# EasyEDA Pro project MSDRV3.eprj, schematic BBC_reuse
Create Date: 2024-11-12; Page Name: P1; Project Name: MSDRV3; Schematic Name: BBC_reuse; Update Date: 2024-11-22; Company: EasyEDA.com; Drawn: EasyEDA; Page Size: A4; Part Number: JLCPCB-002; Reviewed: EasyEDA; Version: V0.1
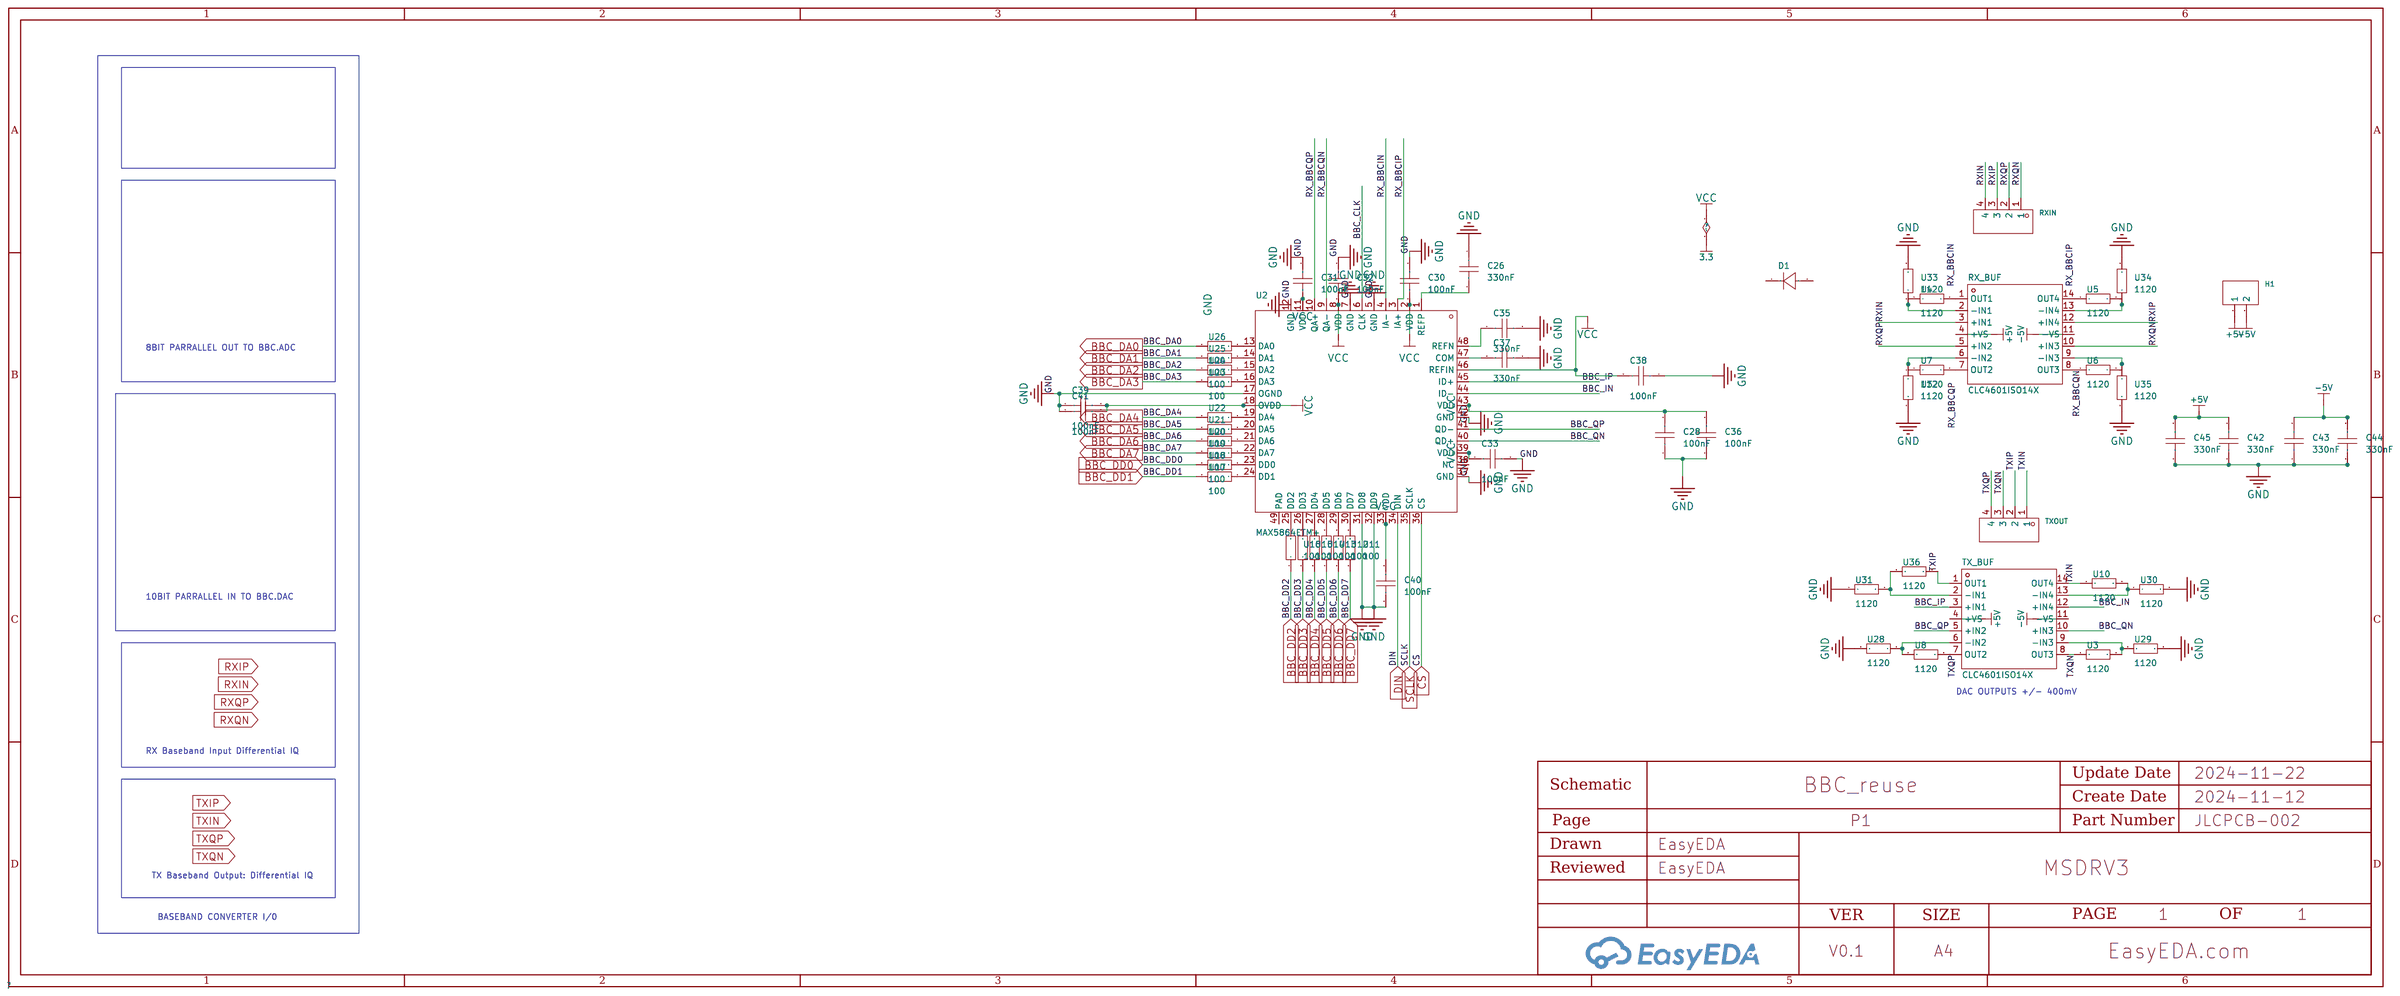
[diagram p2: schematic sheet]

## Parts
C26  330nF  [C0805]
C28  100nF  [C0805]
C30  100nF  [C0805]
C31  100nF  [C0805]
C32  100nF  [C0805]
C33  100nF  [C0805]
C35  330nF  [C0805]
C36  100nF  [C0805]
C37  330nF  [C0805]
C38  100nF  [C0805]
C39  100nF  [C0805]
C40  100nF  [C0805]
C41  100nF  [C0805]
C42  330nF  [C0805]
C43  330nF  [C0805]
C44  330nF  [C0805]
C45  330nF  [C0805]
D1  -  [SMA_L4.4-W2.8-LS5.4-RD]
H1  -  [HDR-TH_2P-P2.54-V-F]
RX_BUF  CLC4601ISO14X  [SOIC-14_L8.7-W3.9-P1.27-LS6.0-BL]
RXIN  -  [HDR-TH_4P-P2.54-V-F]
TX_BUF  CLC4601ISO14X  [SOIC-14_L8.7-W3.9-P1.27-LS6.0-BL]
TXOUT  -  [HDR-TH_4P-P2.54-V-F]
U2  MAX5864ETM+  [QFN-48_L7.0-W7.0-P0.50-BL-EP5.1]
U3  1120  [R0805]
U4  1120  [R0805]
U5  1120  [R0805]
U6  1120  [R0805]
U7  1120  [R0805]
U8  1120  [R0805]
U10  1120  [R0805]
U11  100  [R0805]
U12  100  [R0805]
U13  100  [R0805]
U14  100  [R0805]
U15  100  [R0805]
U16  100  [R0805]
U17  100  [R0805]
U18  100  [R0805]
U19  100  [R0805]
U20  100  [R0805]
U21  100  [R0805]
U22  100  [R0805]
U23  100  [R0805]
U24  100  [R0805]
U25  100  [R0805]
U26  100  [R0805]
U28  1120  [R0805]
U29  1120  [R0805]
U30  1120  [R0805]
U31  1120  [R0805]
U32  1120  [R0805]
U33  1120  [R0805]
U34  1120  [R0805]
U35  1120  [R0805]
U36  1120  [R0805]

## Library data of the parts
C26 C28 C30-C33 C35-C45 = CAP_0805: Supplier Footprint: 0805
D1 = 1N4007: Supplier Footprint: SMA(DO-214AC); Supplier Part: C727081
H1 = HDR-F_2.54_1x2P: Supplier Footprint: Through
RX_BUF TX_BUF = CLC4601ISO14X: Number of Circuits:; Supplier Part: C49944; Supplier Footprint: SOIC-14; JLCPCB Part Class: Extended Part; Supplier: LCSC
RXIN TXOUT = HDR-F_2.54_1x4P: Supplier Footprint: Through
U2 = MAX5864ETM+: Supply Voltage:2.7V~3.3V Supply Voltage:2.7V~3.3V; LCSC Part Name: MAX5864ETM; Supplier Part: C143525; Manufacturer: ADI(亚德诺)/MAXIM(美信); Supplier Footprint: QFN-48-EP(7x7); JLCPCB Part Class: Extended Part; Datasheet: https://atta.szlcsc.com/upload/public/pdf/source/20171204/C143525_15123772477351162683.pdf; Supplier: LCSC; Supply Voltage: 2.7V~3.3V
U3-U8 U10-U26 U28-U36 = 3R00: Supplier Part: C9900008006; JLCPCB Part Class: Extended Part; Supplier: LCSC

## Nets
+5V: C42.2 C45.2 H1.1 RX_BUF.4(+VS) TX_BUF.4(+VS)
-5V: C43.2 C44.2 H1.2 RX_BUF.11(-VS) TX_BUF.11(-VS)
GND: C26.1 C28.1 C30.2 C31.1 C32.1 C33.2 C35.2 C36.1 C37.1 C38.1 C39.1 C40.1 C41.1 C42.1 C43.1 C44.1 C45.1 U2.5(GND) U2.7(GND) U2.12(GND) U2.17(OGND) U2.31(DD8) U2.32(DD9) U2.37(GND) U2.42(GND) U28.2 U29.2 U30.2 U31.1 U32.2 U33.2 U34.2 U35.2
3.3: C28.2 C30.1 C31.2 C32.2 C33.1 C36.2 C38.2 C39.2 C40.2 C41.2 U2.2(VDD) U2.8(VDD) U2.11(VDD) U2.18(OVDD) U2.33(VDD) U2.39(VDD) U2.43(VDD) U2.46(REFIN)
BBC_CLK: U2.6(CLK)
BBC_DA0: U26.2
BBC_DA1: U25.2
BBC_DA2: U24.2
BBC_DA3: U23.2
BBC_DA4: U22.2
BBC_DA5: U21.2
BBC_DA6: U20.2
BBC_DA7: U19.2
BBC_DD0: U18.2
BBC_DD1: U17.2
BBC_DD2: U16.1
BBC_DD3: U15.1
BBC_DD4: U14.1
BBC_DD5: U13.1
BBC_DD6: U12.1
BBC_DD7: U11.1
BBC_IN: TX_BUF.12(+IN4) U2.44(ID-)
BBC_IP: TX_BUF.3(+IN1) U2.45(ID+)
BBC_QN: TX_BUF.10(+IN3) U2.40(QD+)
BBC_QP: TX_BUF.5(+IN2) U2.41(QD-)
CS: U2.36(CS)
DIN: U2.34(DIN)
RX_BBCIN: RX_BUF.1(OUT1) U2.4(IA-) U4.2
RX_BBCIP: RX_BUF.14(OUT4) U2.3(IA+) U5.1
RX_BBCQN: RX_BUF.8(OUT3) U2.9(QA-) U6.1
RX_BBCQP: RX_BUF.7(OUT2) U2.10(QA+) U7.2
RXIN: RX_BUF.3(+IN1) RXIN.4
RXIP: RX_BUF.12(+IN4) RXIN.3
RXQN: RX_BUF.10(+IN3) RXIN.1
RXQP: RX_BUF.5(+IN2) RXIN.2
SCLK: U2.35(SCLK)
TXIN: TX_BUF.14(OUT4) TXOUT.1 U10.1
TXIP: TX_BUF.1(OUT1) TXOUT.2 U36.2
TXQN: TX_BUF.8(OUT3) TXOUT.3 U3.1
TXQP: TX_BUF.7(OUT2) TXOUT.4 U8.2
$1N3982: C37.2 U2.47(COM)
$1N8783: RX_BUF.2(-IN1) U4.1 U33.1
$1N8787: RX_BUF.6(-IN2) U7.1 U32.1
$1N8791: RX_BUF.9(-IN3) U6.2 U35.1
$1N8799: RX_BUF.13(-IN4) U5.2 U34.1
$1N9385: TX_BUF.6(-IN2) U8.1 U28.1
$1N9388: TX_BUF.13(-IN4) U10.2 U30.1
$1N9391: TX_BUF.9(-IN3) U3.2 U29.1
$1N10591: U2.30(DD7) U11.2
$1N10629: U2.29(DD6) U12.2
$1N10667: U2.28(DD5) U13.2
$1N10705: U2.27(DD4) U14.2
$1N10743: U2.26(DD3) U15.2
$1N10781: U2.25(DD2) U16.2
$1N10830: U2.24(DD1) U17.1
$1N10868: U2.23(DD0) U18.1
$1N10906: U2.22(DA7) U19.1
$1N10944: U2.21(DA6) U20.1
$1N10982: U2.20(DA5) U21.1
$1N11020: U2.19(DA4) U22.1
$1N11058: U2.16(DA3) U23.1
$1N11162: U2.15(DA2) U24.1
$1N11200: U2.14(DA1) U25.1
$1N11238: U2.13(DA0) U26.1
$1N11679: C35.1 U2.48(REFN)
$1N11690: C26.2 U2.1(REFP)
Net-(TX_BUF-2): TX_BUF.2(-IN1) U31.2 U36.1

Not connected (* = marked no-connect by the designer): D1 1(K) 2(A); U2 38(NC) 49(PAD)

## Notes on the sheet
- 8BIT PARRALLEL OUT TO BBC.ADC
- 10BIT PARRALLEL IN TO BBC.DAC
- DAC OUTPUTS +/- 400mV
- RX Baseband Input Differential IQ
- TX Baseband Output: Differential IQ
- BASEBAND CONVERTER I/0
